# EasyEDA Pro project 第十五届蓝桥杯EDA赛项模拟试题二（嘉立创EDA提供）.eprj, schematic SCH-PockerMultimater1
Create Date: 2024-02-17; Page Name: P1; Project Name: 第十五届蓝桥杯EDA赛项模拟试题二（嘉立创EDA提供）; Schematic Name: SCH-PockerMultimater1; Update Date: 2024-04-05; Company: 深圳嘉立创科技集团股份有限公司; Drawed: LCEDA_02; Page Size: A4; Part Number: JLC-PCB-001; Reviewed: 嘉立创EDA; Version: V1.0
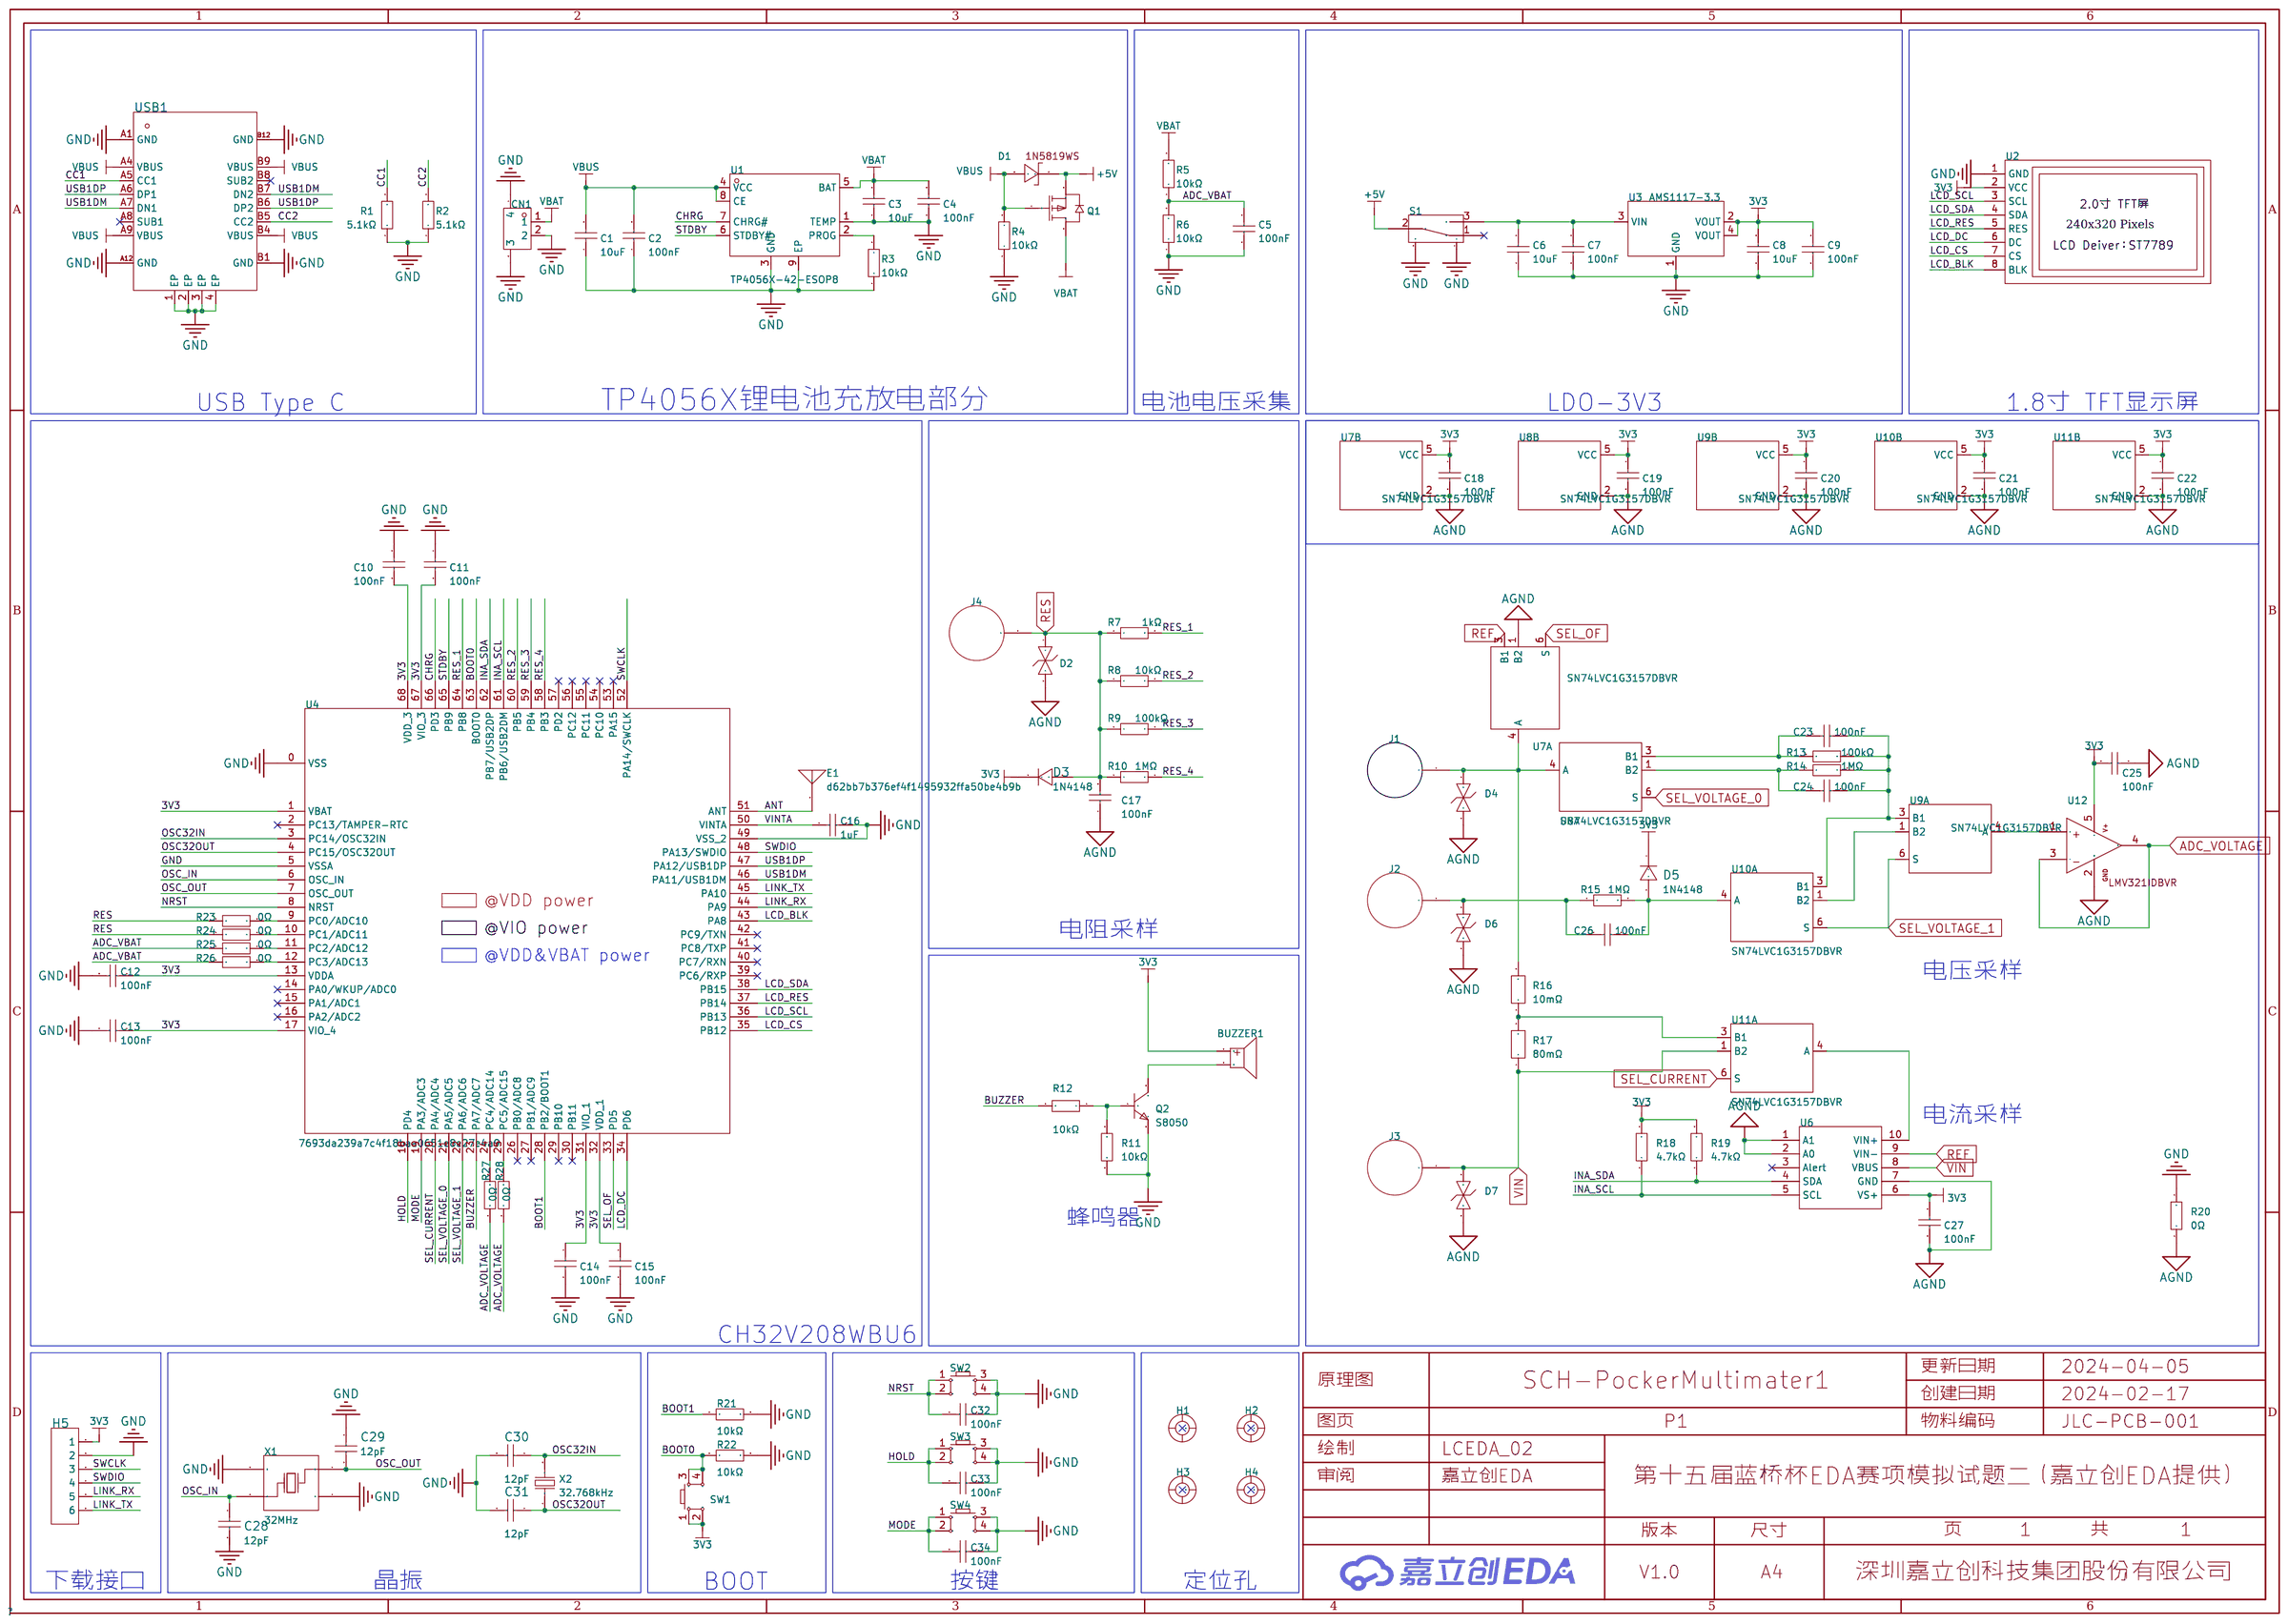
[diagram p0: schematic sheet]

## Parts
BUZZER1  3kHz  [BUZ-TH_BD9.0-P5.00-D0.6-FD]
C1  10uF  [C0603]
C2  100nF  [C0603]
C3  10uF  [C0603]
C4  100nF  [C0603]
C5  100nF  [C0603]
C6  10uF  [C0603]
C7  100nF  [C0603]
C8  10uF  [C0603]
C9  100nF  [C0603]
C10  100nF  [C0603]
C11  100nF  [C0603]
C12  100nF  [C0603]
C13  100nF  [C0603]
C14  100nF  [C0603]
C15  100nF  [C0603]
C16  1uF  [C0603]
C17  100nF  [C0603]
C18  100nF  [C0603]
C19  100nF  [C0603]
C20  100nF  [C0603]
C21  100nF  [C0603]
C22  100nF  [C0603]
C23  100nF  [C0603]
C24  100nF  [C0603]
C25  100nF  [C0603]
C26  100nF  [C0603]
C27  100nF  [C0603]
C28  12pF  [C0603]
C29  12pF  [C0603]
C30  12pF  [C0603]
C31  12pF  [C0603]
C32  100nF  [C0603]
C33  100nF  [C0603]
C34  100nF  [C0603]
CN1  1.5K-BH-2PWB  [CONN-SMD_2P-P1.50_HDGC_1.5K-BH-2PWB]
D1  1N5819WS  [SOD-323_L1.8-W1.3-LS2.5-RD]
D2  SJD12C40L01  [SOD-123_L2.8-W1.8-LS3.7-BI]
D3  1N4148  [SOD-323_L1.8-W1.3-LS2.5-RD]
D4  SJD12C40L01  [SOD-123_L2.8-W1.8-LS3.7-BI]
D5  1N4148  [SOD-323_L1.8-W1.3-LS2.5-RD]
D6  SJD12C40L01  [SOD-123_L2.8-W1.8-LS3.7-BI]
D7  SJD12C40L01  [SOD-123_L2.8-W1.8-LS3.7-BI]
E1  d62bb7b376ef4f1495932ffa50be4b9b  [ANT-F-1-2.4G-1.6]
H1  -  [M3]
H2  -  [M3]
H3  -  [M3]
H4  -  [M3]
H5  2.54-1x6P直针  [HDR-TH_6P-P2.54-V-M-1]
J1  -  [香蕉头-4mm-24.302.*]
J2  -  [香蕉头-4mm-24.302.*]
J3  -  [香蕉头-4mm-24.302.*]
J4  -  [香蕉头-4mm-24.302.*]
Q1  AO3401A  [SOT-23_L2.9-W1.3-P1.90-LS2.4-BR]
Q2  S8050  [SOT-23-3_L3.0-W1.7-P0.95-LS2.9-BR]
R1  5.1kΩ  [R0603]
R2  5.1kΩ  [R0603]
R3  10kΩ  [R0603]
R4  10kΩ  [R0603]
R5  10kΩ  [R0603]
R6  10kΩ  [R0603]
R7  1kΩ  [R0603]
R8  10kΩ  [R0603]
R9  100kΩ  [R0603]
R10  1MΩ  [R0603]
R11  10kΩ  [R0603]
R12  10kΩ  [R0603]
R13  100kΩ  [R0603]
R14  1MΩ  [R0603]
R15  1MΩ  [R0603]
R16  10mΩ  [R2512]
R17  80mΩ  [R2512]
R18  4.7kΩ  [R0603]
R19  4.7kΩ  [R0603]
R20  0Ω  [R0805]
R21  10kΩ  [R0603]
R22  10kΩ  [R0603]
R23  0Ω  [R0402]
R24  0Ω  [R0402]
R25  0Ω  [R0402]
R26  0Ω  [R0402]
R27  0Ω  [R0402]
R28  0Ω  [R0402]
S1  SK-12E12-G5  [SW-TH_SK-12E12-G5]
SW1  TS-1002S-07026C  [KEY-SMD_4P-L6.0-W6.0-P4.50-LS9.0]
SW2  TS-1002S-07026C  [KEY-SMD_4P-L6.0-W6.0-P4.50-LS9.0]
SW3  TS-1002S-07026C  [KEY-SMD_4P-L6.0-W6.0-P4.50-LS9.0]
SW4  TS-1002S-07026C  [KEY-SMD_4P-L6.0-W6.0-P4.50-LS9.0]
U1  TP4056X-42-ESOP8  [TP4056-SOP8]
U2  -  [2.0寸TFT屏幕模块-8Pin]
U3  AMS1117-3.3  [SOT-223-3_L6.5-W3.4-P2.30-LS7.0-BR]
U4  7693da239a7c4f18baa0651e8e27e4a9  [QFN68(8x8)]
U6  INA226AIDGSR  [MSOP-10_L3.0-W3.0-P0.50-LS5.0-BL]
U7  SN74LVC1G3157DBVR  [SOT-23-6_L2.9-W1.6-P0.95-LS2.8-BR]  (sections 1,2)
U8  SN74LVC1G3157DBVR  [SOT-23-6_L2.9-W1.6-P0.95-LS2.8-BR]  (sections 1,2)
U9  SN74LVC1G3157DBVR  [SOT-23-6_L2.9-W1.6-P0.95-LS2.8-BR]  (sections 1,2)
U10  SN74LVC1G3157DBVR  [SOT-23-6_L2.9-W1.6-P0.95-LS2.8-BR]  (sections 1,2)
U11  SN74LVC1G3157DBVR  [SOT-23-6_L2.9-W1.6-P0.95-LS2.8-BR]  (sections 1,2)
U12  LMV321IDBVR  [SOT-23-5_L3.0-W1.7-P0.95-LS2.8-BR]
USB1  KH-TYPE-C-16P  [USB-C-SMD_KH-TYPE-C-16P]
X1  32MHz  [OSC-SMD_4P-L3.2-W2.5-BL]
X2  32.768kHz  [FC-135R_L3.2-W1.5]

## Library data of the parts
BUZZER1 = HNB09A03: 驱动方式:有源(内含驱动线路);构造类型:电磁式;额定电压:3V;工作电压:1.5V~4.5V;消耗电流:30mA;频率:3kHz;声压(SPL):85dB@10cm;直径(φD):9mm;长度:-;宽度:-;高度:5.5mm;工作温度:-20℃~+70℃;; LCSC Part Name: 电磁式有源一体蜂鸣器HNB09A03; Supplier Part: C96102; Manufacturer: 华能; Supplier Footprint: 插件,D=9mm; Datasheet: https://atta.szlcsc.com/upload/public/pdf/source/20170522/1495448326172.pdf; Supplier: LCSC; Oscillator Circuit: 有源(内含驱动线路); Technology Type: 电磁式; Rated Voltage: 3V; Operating Voltage: 1.5V~4.5V; Current Consumption: 30mA; Sound Pressure Level (SPL): 85dB@10cm; Diameter (φD): 9mm; Height: 5.5mm; Operating Temperature: -20℃~+70℃
C1 C3 = CL10A106MA8NRNC: 容值:10uF;精度:±20%;额定电压:25V;材质(温度系数):X5R;; LCSC Part Name: 10uF ±20% 25V; Supplier Part: C96446; Manufacturer: SAMSUNG(三星); Supplier Footprint: 0603; JLCPCB Part Class: 基础库; Datasheet: https://atta.szlcsc.com/upload/public/pdf/source/20170325/1490427913016.pdf; Supplier: LCSC; Tolerance: ±20%; Voltage Rated: 25V; Temperature Coefficient: X5R
C2 C4 = CC0603KRX7R9BB104: 容值:100nF;精度:±10%;额定电压:50V;材质(温度系数):X7R;; LCSC Part Name: 100nF ±10% 50V; Supplier Part: C14663; Manufacturer: YAGEO(国巨); Supplier Footprint: 0603; JLCPCB Part Class: Basic Part; Datasheet: https://atta.szlcsc.com/upload/public/pdf/source/20180910/C282072_33301C7F631E79921B82A8DAC6BCC5B3.pdf; Supplier: LCSC; Tolerance: ±10%; Voltage Rated: 50V; Temperature Coefficient: X7R
C5 C7 C9-C15 C17-C27 C32-C34 = CC0603KRX7R9BB104: 容值:100nF;精度:±10%;额定电压:50V;材质(温度系数):X7R;; LCSC Part Name: 100nF ±10% 50V; Supplier Part: C14663; Manufacturer: YAGEO(国巨); Supplier Footprint: 0603; Datasheet: https://atta.szlcsc.com/upload/public/pdf/source/20180910/C282072_33301C7F631E79921B82A8DAC6BCC5B3.pdf; Supplier: LCSC; Tolerance: ±10%; Voltage Rated: 50V; Temperature Coefficient: X7R
C6 C8 = CL10A106MA8NRNC: 容值:10uF;精度:±20%;额定电压:25V;材质(温度系数):X5R;; LCSC Part Name: 10uF ±20% 25V; Supplier Part: C96446; Manufacturer: SAMSUNG(三星); Supplier Footprint: 0603; Datasheet: https://atta.szlcsc.com/upload/public/pdf/source/20170325/1490427913016.pdf; Supplier: LCSC; Tolerance: ±20%; Voltage Rated: 25V; Temperature Coefficient: X5R
C16 = CL10A105KB8NNNC: 容值:1uF;精度:±10%;额定电压:50V;材质(温度系数):X5R;; LCSC Part Name: 1uF ±10% 50V; Supplier Part: C15849; Manufacturer: SAMSUNG(三星); Supplier Footprint: 0603; Datasheet: https://atta.szlcsc.com/upload/public/pdf/source/20160103/1457707679084.pdf; Supplier: LCSC; Tolerance: ±10%; Voltage Rated: 50V; Temperature Coefficient: X5R
C28-C31 = CL10C120JB8NNNC: 容值:12pF;精度:±5%;额定电压:50V;材质(温度系数):C0G;; LCSC Part Name: 12pF ±5% 50V; Supplier Part: C38523; Manufacturer: SAMSUNG(三星); Supplier Footprint: 0603; Datasheet: https://atta.szlcsc.com/upload/public/pdf/source/20160218/1457707763339.pdf; Supplier: LCSC; Tolerance: ±5%; Voltage Rated: 50V; Temperature Coefficient: C0G
CN1 = 1.5K-BH-2PWB: 1.5间距卧式贴片针座 2P; LCSC Part Name: 1x2P 间距P=1.5mm 卧式 SMT; Supplier Part: C2919592; Manufacturer: HDGC(华德共创); Supplier Footprint: SMD,P=1.5mm; Datasheet: https://atta.szlcsc.com/upload/public/pdf/source/20211115/B8CFA05E67C19F0A682ADA73BF1C4303.pdf; Supplier: LCSC
D1 = 1N5819WS_C191023: 直流反向耐压(Vr):40V;平均整流电流(Io):1A;正向压降(Vf):600mV@1A;; LCSC Part Name: 40V1A600mV@1A; Supplier Part: C191023; Manufacturer: Hottech(合科泰); Supplier Footprint: SOD-323; JLCPCB Part Class: BasicPart; Datasheet: https://atta.szlcsc.com/upload/public/pdf/source/20220428/3CB86FD8D28D653594B4E35F9D5AEFD9.pdf; Supplier: LCSC; Reverse Voltage (Vr): 40V; Average Rectified Current (Io): 1A; Forward Voltage (Vf@If): 600mV@1A
D2 D4 D6 D7 = SJD12C40L01: LCSC Part Name: 双向ESD; Supplier Part: C313287; Manufacturer: Brightking(君耀电子); Supplier Footprint: SOD-123S; JLCPCB Part Class: 扩展库; Datasheet: https://atta.szlcsc.com/upload/public/pdf/source/20190308/C313298_C5F5DA7B871929800C41255070D52D63.pdf; Supplier: LCSC
D3 D5 = 1N4148WS_C2128: 二极管配置:独立式;功率:200mW;直流反向耐压(Vr):100V;平均整流电流(Io):150mA;正向压降(Vf):1.25V@150mA;反向电流(Ir):1uA@75V;反向恢复时间(trr):4ns;工作温度:+150℃@(Tj);; LCSC Part Name: 100V 150mA 4ns T4; Supplier Part: C2128; Manufacturer: CJ(江苏长电/长晶); Supplier Footprint: SOD-323; Supplier: LCSC; Diode Configuration: 独立式; Power Dissipation: 200mW; Reverse Voltage (Vr): 100V; Average Rectified Current (Io): 150mA; Forward Voltage (Vf@If): 1.25V@150mA; Reverse Leakage Current: 1uA@75V; Reverse Recovery Time (trr): 4ns; Operating Temperature: +150℃@(Tj)
E1 = ANTENNA
H1-H4 = M3: Manufacturer: Shuntian(顺天五金); Manufacturer Part: M3x10+6; Supplier Part: C551322; Supplier: LCSC; JLCPCB Part Class: 扩展库
H5 = 2.54-1x6P直针: 排数:单排;总PIN位数:6;间距:2.54mm;插针结构:1x6P;行距:-;安装类型:直插;圆针/方针:方针;额定电流:3A;额定电压:-;配合针长度:-;塑高:-;触头材质:黄铜;触头镀层:-;工作温度范围:-40℃~+105℃;颜色:黑色;; LCSC Part Name: 2.54mm 1x6P 直插 方针; Supplier Part: C37208; Manufacturer: BOOMELE(博穆精密); Supplier Footprint: 直插,P=2.54mm; Supplier: LCSC; Number of Rows: 单排; Number of Pins: 6; Pitch: 2.54mm; Pin Structure: 1x6P; Mounting Type: 直插; Circluar Pins/Square Pins: 方针; Current Rating (Max): 3A; Contact Material: 黄铜; Operating Temperature Range: -40℃~+105℃; Color: 黑色
J1 = 香蕉头-4mm-24.302.2(黑): Supplier: LCSC; Supplier Part: C106271; Manufacturer Part: 24.302.2; Manufacturer: AMASS(艾迈斯); Datasheet: https://atta.szlcsc.com/upload/public/pdf/source/20170413/1492062723503.pdf
J2-J4 = 香蕉头-4mm-24.302.1(红): Supplier: LCSC; Supplier Part: C99100; Manufacturer: AMASS(艾迈斯); Manufacturer Part: 24.302.1; Datasheet: https://atta.szlcsc.com/upload/public/pdf/source/20170413/1492062723503.pdf; JLCPCB Part Class: 扩展库
Q1 = AO3401A_C15127: 类型:P沟道;漏源电压(Vdss):30V;连续漏极电流(Id):4A;功率(Pd):1.4W;导通电阻(RDS(on)@Vgs,Id):44mΩ@10V,4.3A;; LCSC Part Name: P沟道30V4A; Supplier Part: C15127; Manufacturer: AOS; Supplier Footprint: SOT-23-3L; JLCPCB Part Class: BasicPart; Datasheet: https://atta.szlcsc.com/upload/public/pdf/source/20160507/1462613609053.pdf; Supplier: LCSC; Type: P沟道; Drain Source Voltage (Vdss): 30V; Continuous Drain Current (Id): 4A; Power Dissipation (Pd): 1.4W; Drain Source On Resistance (RDS(on)@Vgs,Id): 44mΩ@10V,4.3A; Gate Threshold Voltage (Vgs(th)@Id): 1.3V@250uA
Q2 = S8050 J3Y_C2146: 晶体管类型:NPN;集射极击穿电压(Vceo):25V;集电极电流(Ic):500mA;功率(Pd):300mW;直流电流增益(hFE@Ic,Vce):200@50mA,1V;; LCSC Part Name: NPN 25V 500mA (200-350); Supplier Part: C2146; Manufacturer: CJ(江苏长电/长晶); Supplier Footprint: SOT-23; Datasheet: https://atta.szlcsc.com/upload/public/pdf/source/20140809/1457707209234.pdf; Supplier: LCSC; Transistor Type: NPN; Collector-Emitter Breakdown Voltage (Vceo): 25V; Collector Current (Ic): 500mA; Power Dissipation (Pd): 300mW; Collector Cut-Off Current (Icbo): 100nA; Collector-Emitter Saturation Voltage (VCE(sat)@Ic,Ib): 600mV@500mA,50mA; DC Current Gain (hFE@Ic,Vce): 200@50mA,1V; Transition Frequency (fT): 150MHz; Operating Temperature: +150℃@(Tj)
R1 R2 = 0603WAF5101T5E: 电阻类型:厚膜电阻;阻值:5.1kΩ;精度:±1%;功率:100mW;; LCSC Part Name: 5.1kΩ ±1% 100mW; Supplier Part: C23186; Manufacturer: UNI-ROYAL(厚声); Supplier Footprint: 0603; Datasheet: https://atta.szlcsc.com/upload/public/pdf/source/20200306/C422600_1E6D84923E4A46A82E41ADD87F860B5C.pdf; Supplier: LCSC; Type: 厚膜电阻; Tolerance: ±1%; Power(Watts): 100mW; Temperature Coefficient: ±100ppm/℃; Overload Voltage (Max): 75V; Operating Temperature Range: -55℃~+155℃
R3 R4 = 0603WAF1002T5E: 电阻类型:厚膜电阻;阻值:10kΩ;精度:±1%;功率:100mW;; LCSC Part Name: 厚膜电阻 10kΩ ±1% 100mW; Supplier Part: C25804; Manufacturer: UNI-ROYAL(厚声); Supplier Footprint: 0603; JLCPCB Part Class: 基础库; Datasheet: https://atta.szlcsc.com/upload/public/pdf/source/20200306/C422600_1E6D84923E4A46A82E41ADD87F860B5C.pdf; Supplier: LCSC; Type: 厚膜电阻; Tolerance: ±1%; Power(Watts): 100mW; Temperature Coefficient: ±100ppm/℃; Overload Voltage (Max): 75V; Operating Temperature Range: -55℃~+155℃
R5 R6 R8 = ARG03BTC1002: 电阻类型:薄膜电阻;阻值:10kΩ;精度:±0.1%;功率:100mW;; LCSC Part Name: 10kΩ ±0.1% 100mW; Supplier Part: C309083; Manufacturer: Viking(光颉); Supplier Footprint: 0603; JLCPCB Part Class: 扩展库; Datasheet: https://atta.szlcsc.com/upload/public/pdf/source/20180927/C309083_646512A0E222CA692A136FBD28365627.pdf; Supplier: LCSC; Type: 薄膜电阻; Tolerance: ±0.1%; Power(Watts): 100mW; Temperature Coefficient: ±25ppm/℃; Overload Voltage (Max): 75V; Operating Temperature Range: -55℃~+155℃
R7 = RT0603BRD071KL: 电阻类型:薄膜电阻;阻值:1kΩ;精度:±0.1%;功率:100mW;; LCSC Part Name: 1kΩ ±0.1% 100mW; Supplier Part: C110776; Manufacturer: YAGEO(国巨); Supplier Footprint: 0603; JLCPCB Part Class: 扩展库; Datasheet: https://atta.szlcsc.com/upload/public/pdf/source/20170704/1499151282044.pdf; Supplier: LCSC; Type: 薄膜电阻; Tolerance: ±0.1%; Power(Watts): 100mW; Temperature Coefficient: ±25ppm/℃; Overload Voltage (Max): 75V; Operating Temperature Range: -55℃~+155℃
R9 R13 = RT0603BRD07100KL: 电阻类型:薄膜电阻;阻值:100kΩ;精度:±0.1%;功率:100mW;; LCSC Part Name: 100kΩ ±0.1% 100mW; Supplier Part: C122538; Manufacturer: YAGEO(国巨); Supplier Footprint: 0603; JLCPCB Part Class: 扩展库; Datasheet: https://atta.szlcsc.com/upload/public/pdf/source/20170721/C122538_1500619326323834092.pdf; Supplier: LCSC; Type: 薄膜电阻; Tolerance: ±0.1%; Power(Watts): 100mW; Temperature Coefficient: ±25ppm/℃; Overload Voltage (Max): 75V; Operating Temperature Range: -55℃~+155℃
R10 R14 R15 = ARG03BTC1004: 电阻类型:薄膜电阻;阻值:1MΩ;精度:±0.1%;功率:100mW;; LCSC Part Name: 1MΩ ±0.1% 100mW; Supplier Part: C335092; Manufacturer: Viking(光颉); Supplier Footprint: 0603; JLCPCB Part Class: 扩展库; Datasheet: https://atta.szlcsc.com/upload/public/pdf/source/20181207/C335092_AFEFD710796D6AB4B37DCA95E2A57414.pdf; Supplier: LCSC; Type: 薄膜电阻; Tolerance: ±0.1%; Power(Watts): 100mW; Temperature Coefficient: ±25ppm/℃; Overload Voltage (Max): 75V; Operating Temperature Range: -55℃~+155℃
R11 R12 R21 R22 = 0603WAF1002T5E: 电阻类型:厚膜电阻;阻值:10kΩ;精度:±1%;功率:100mW;; LCSC Part Name: 厚膜电阻 10kΩ ±1% 100mW; Supplier Part: C25804; Manufacturer: UNI-ROYAL(厚声); Supplier Footprint: 0603; Datasheet: https://atta.szlcsc.com/upload/public/pdf/source/20200306/C422600_1E6D84923E4A46A82E41ADD87F860B5C.pdf; Supplier: LCSC; Type: 厚膜电阻; Tolerance: ±1%; Power(Watts): 100mW; Temperature Coefficient: ±100ppm/℃; Overload Voltage (Max): 75V; Operating Temperature Range: -55℃~+155℃
R16 = PE2512FKE070R01L: 阻值:10mΩ;精度:±1%;功率:1W;温度系数:±50ppm/℃;电阻类型:-;; LCSC Part Name: 10mΩ ±1% 1W; Supplier Part: C2093321; Manufacturer: YAGEO(国巨); Supplier Footprint: 2512; JLCPCB Part Class: 扩展库; Datasheet: https://atta.szlcsc.com/upload/public/pdf/source/20211020/C6103334F76DC954DA6F525702694423.pdf; Supplier: LCSC; Tolerance: ±1%; Power(Watts): 1W; Temperature Coefficient: ±50ppm/℃; Operating Temperature Range: -55℃~+170℃
R17 = 25121WF800MT4E: 阻值:80mΩ;精度:±1%;功率:1W;温度系数:±800ppm/℃;电阻类型:厚膜电阻;; LCSC Part Name: 80mΩ ±1% 1W 厚膜电阻; Supplier Part: C421509; Manufacturer: UNI-ROYAL(厚声); Supplier Footprint: 2512; JLCPCB Part Class: 扩展库; Datasheet: https://atta.szlcsc.com/upload/public/pdf/source/20200306/C422600_1E6D84923E4A46A82E41ADD87F860B5C.pdf; Supplier: LCSC; Tolerance: ±1%; Power(Watts): 1W; Overload Voltage (Max): 200V; Temperature Coefficient: ±800ppm/℃; Type: 厚膜电阻; Operating Temperature Range: -55℃~+155℃
R18 R19 = 0603WAF4701T5E: 阻值:4.7kΩ;精度:±1%;功率:100mW;温度系数:±100ppm/℃;电阻类型:厚膜电阻;; LCSC Part Name: 4.7kΩ ±1% 100mW 厚膜电阻; Supplier Part: C23162; Manufacturer: UNI-ROYAL(厚声); Supplier Footprint: 0603; JLCPCB Part Class: Basic Part; Datasheet: https://atta.szlcsc.com/upload/public/pdf/source/20200306/C422600_1E6D84923E4A46A82E41ADD87F860B5C.pdf; Supplier: LCSC; Tolerance: ±1%; Power(Watts): 100mW; Overload Voltage (Max): 75V; Temperature Coefficient: ±100ppm/℃; Type: 厚膜电阻; Operating Temperature Range: -55℃~+155℃
R20 = 0805W8F0000T5E: 阻值:0Ω;精度:±1%;功率:125mW;温度系数:±800ppm/℃;电阻类型:厚膜电阻;; LCSC Part Name: 0Ω ±1% 125mW 厚膜电阻; Supplier Part: C17477; Manufacturer: UNI-ROYAL(厚声); Supplier Footprint: 0805; JLCPCB Part Class: 基础库; Datasheet: https://atta.szlcsc.com/upload/public/pdf/source/20200306/C422600_1E6D84923E4A46A82E41ADD87F860B5C.pdf; Supplier: LCSC; Tolerance: ±1%; Power(Watts): 125mW; Overload Voltage (Max): 150V; Temperature Coefficient: ±800ppm/℃; Type: 厚膜电阻; Operating Temperature Range: -55℃~+155℃
R23-R28 = 0402WGF0000TCE: 阻值:0Ω;精度:±1%;功率:62.5mW;温度系数:±800ppm/℃;电阻类型:厚膜电阻;; LCSC Part Name: 0Ω ±1% 62.5mW 厚膜电阻; Supplier Part: C17168; Manufacturer: UNI-ROYAL(厚声); Supplier Footprint: 0402; JLCPCB Part Class: 基础库; Datasheet: https://atta.szlcsc.com/upload/public/pdf/source/20200306/C422600_1E6D84923E4A46A82E41ADD87F860B5C.pdf; Supplier: LCSC; Tolerance: ±1%; Power(Watts): 62.5mW; Overload Voltage (Max): 50V; Temperature Coefficient: ±800ppm/℃; Type: 厚膜电阻; Operating Temperature Range: -55℃~+155℃
S1 = SK-12E12-G5: 额定电流(DC):-;额定电压(DC):-;额定电流(AC):-;额定电压(AC):-;电路结构:单刀双掷;安装方式:卧插;机械寿命:5千次;; LCSC Part Name: 卧插双档 滑动开关; Supplier Part: C136720; Manufacturer: 韩国韩荣; Supplier Footprint: 插件; JLCPCB Part Class: 扩展库; Datasheet: https://atta.szlcsc.com/upload/public/pdf/source/20210810/880D64C2F8CCE477762EFCC00B7B7681.pdf; Supplier: LCSC; Circuit: 单刀双掷; Mounting Style: 卧插; Mechanical Life: 5千次; Actuator Style: 矩形柱状; Pin Style: PC引脚; Operating Temperature: -25℃~+70℃; Switch Height: 10.6mm
SW1-SW4 = TS-1002S-07026C: 触点电流:50mA;额定电压(DC):12V;电路结构:单刀单掷;安装方式:立贴;带灯:-;机械寿命:-;; LCSC Part Name: 6*6*7mm 立贴 轻触开关; Supplier Part: C455114; Manufacturer: XUNPU(讯普); Supplier Footprint: SMD,6x6mm; JLCPCB Part Class: 扩展库; Datasheet: https://atta.szlcsc.com/upload/public/pdf/source/20191118/C455114_772E06E35D310AADD33EBA639F3876D6.pdf; Supplier: LCSC; Contact Current: 50mA; Voltage Rating (DC): 12V; Circuit: 单刀单掷; Mounting Style: 立贴; Actuator Style: 圆形按钮; Switch Length: 6mm; Switch Width: 6mm; Switch Height: 7mm
U1 = TP4056X-42-ESOP8: Supplier Part: C2763448; Manufacturer: TOPPOWER(南京拓微); Supplier Footprint: SOP-8-EP-150mil; JLCPCB Part Class: 扩展库; Datasheet: https://atta.szlcsc.com/upload/public/pdf/source/20221111/3D7D53D5011BF4ED4C4D0D9BFDBB1404.pdf; Supplier: LCSC
U2 = 2.0英寸TFT屏幕模块-8Pin
U3 = AMS1117-3.3_C6186: 输出类型:固定;输出极性:正;最大输入电压:-;输出电压:3.3V;输出电流:1A;电源纹波抑制比(PSRR):72dB@(120Hz);; LCSC Part Name: 输出3.3V 1A; Supplier Part: 、; Manufacturer: AMS; Supplier Footprint: SOT-223; Datasheet: https://atta.szlcsc.com/upload/public/pdf/source/20180727/C6186_7A095716F0823C02F1997A905E26C086.pdf; Supplier: LCSC; Output Type: 固定; Output Polarity: 正; Number of Outputs: 1; Output Voltage: 3.3V; Dropout Voltage: 1.3V@(800mA); Output Current: 1A; Power Supply Rejection Ratio (PSRR): 72dB@(120Hz)
U4 = CH32V208WBU6: Datasheet: file:///E:/Users/win/Downloads/CH32V208DS0.PDF; Manufacturer: WCH(南京沁恒); Supplier: LCSC; Supplier Part: C5187528
U6 = INA226AIDGSR: INA226 支持报警功能的 36V、双向、超高精度、低侧/高侧、I2C 输出电流/功率监控器; Supplier Part: C49851; Manufacturer: TI(德州仪器); Supplier Footprint: MSOP-10; JLCPCB Part Class: 扩展库; Datasheet: https://www.ti.com/cn/lit/gpn/ina226; Supplier: LCSC; Supply Voltage: 0V~36V; Operating Temperature: -40℃~+125℃
U7-U11 = SN74LVC1G3157DBVR: SN74LVC1G3157 1 通道 2:1 模拟开关; Supplier Part: C10426; Manufacturer: TI(德州仪器); Supplier Footprint: SOT-23-6; Datasheet: https://atta.szlcsc.com/upload/public/pdf/source/20121212/1457706567634.pdf; Supplier: LCSC
U12 = LMV321IDBVR_C7972: 运放类型:General Purpose;放大器组数:1;增益带宽积（GBP）:1MHz;压摆率（SR）:1 V/us;电源电压:2.7V ~ 5.5V, ±1.35V ~ 2.75V;各通道供电电流:130uA;; Supplier Part: C7972; Manufacturer: TI(德州仪器); Supplier Footprint: SOT-23-5; JLCPCB Part Class: 扩展库; Datasheet: https://atta.szlcsc.com/upload/public/pdf/source/20170703/1499081241148.pdf; Supplier: LCSC; Amplifier Type: General Purpose; Number of Circuits: 1; Gain Bandwidth Product（GBP）: 1MHz; Slew Rate（SR）: 1 V/us; Output Type: Rail-to-Rail; Supply Voltage（Single）: 2.7V ~ 5.5V, ±1.35V ~ 2.75V; Iq per channel (Typ): 130uA; Operating Temperature: -40°C ~ 125°C
USB1 = KH-TYPE-C-16P: Type-C母座 16PIN 立式四角贴板无压片; LCSC Part Name: Type-C母座; Supplier Part: C709357; Manufacturer: kinghelm(金航标); Supplier: LCSC
X1 = X322532MMB4SI: 频率:32MHz;频率公差:±10ppm;负载电容:10pF;; LCSC Part Name: 32MHz ±10ppm 10pF YSX321SL; Supplier Part: C113671; Manufacturer: YXC(扬兴晶振); Supplier Footprint: SMD3225-4P; Datasheet: https://atta.szlcsc.com/upload/public/pdf/source/20210329/C112971_1F611BDC486E193C1706F6D8EB5AA189.pdf; Supplier: LCSC; Crystal Type: 贴片无源晶振; Frequency Tolerance: ±10ppm; Frequency Stability: ±30ppm; Load Capacitance: 10pF; Operating Temperature: -40℃~+85℃
X2 = Q13FC1350000400: 频率:32.768kHz;频率公差:±20ppm;负载电容:12.5pF;; LCSC Part Name: 32.768kHz ±20ppm 12.5pF; Supplier Part: C32346; Manufacturer: EPSON(爱普生); Supplier Footprint: SMD3215-2P; Datasheet: https://atta.szlcsc.com/upload/public/pdf/source/20190108/C32346_746D6B07EAF90824457A96480007685F.pdf; Supplier: LCSC; Crystal Type: 贴片无源晶振; Frequency Tolerance: ±20ppm; Load Capacitance: 12.5pF; Equivalent Series Resistance (ESR): 70kΩ; Operating Temperature: -40℃~+85℃

## Nets
3V3: BUZZER1.1 C8.2 C9.1 C10.1 C11.2 C12.1 C13.1 C14.1 C15.1 C18.1 C19.1 C20.1 C21.1 C22.1 C25.1 C27.1 D3.1(K) D5.1(K) H5.1 R18.2 R19.2 SW1.1 SW1.2 U2.2(VCC) U3.2(VOUT) U3.4(VOUT) U4.1(VBAT) U4.13(VDDA) U4.17(VIO_4) U4.31(VIO_1) U4.32(VDD_1) U4.67(VIO_3) U4.68(VDD_3) U6.6(VS+) U7.5(VCC) U8.5(VCC) U9.5(VCC) U10.5(VCC) U11.5(VCC) U12.5(V+)
+5V: D1.1(C) Q1.2(S) S1.2
AGND: C17.1 C18.2 C19.2 C20.2 C21.2 C22.2 C25.2 C27.2 D2.2 D4.2 D6.2 D7.2 R20.1 U6.1(A1) U6.2(A0) U6.7(GND) U7.1(B2) U7.2(GND) U8.2(GND) U9.2(GND) U10.2(GND) U11.2(GND) U12.2(GND)
GND: C1.1 C2.1 C3.1 C4.1 C5.2 C6.1 C7.2 C8.1 C9.2 C10.2 C11.1 C12.2 C13.2 C14.2 C15.2 C16.2 C28.2 C29.1 C30.2 C31.2 C32.1 C33.1 C34.1 CN1.2 CN1.3 CN1.4 H5.2 Q2.2(E) R1.1 R2.1 R3.1 R4.1 R6.1 R11.2 R20.2 R21.2 R22.2 S1.4 S1.5 SW2.3 SW2.4 SW3.3 SW3.4 SW4.3 SW4.4 U1.1(TEMP) U1.3(GND) U1.9(EP) U2.1(GND) U3.1(GND) U4.0(VSS) U4.5(VSSA) U4.49(VSS_2) USB1.1(EP) USB1.2(EP) USB1.3(EP) USB1.4(EP) USB1.A1(GND) USB1.A12(GND) USB1.B1(GND) USB1.B12(GND) X1.2(GND) X1.4(GND)
VBAT: C3.2 C4.2 CN1.1 Q1.3(D) R5.2 U1.5(BAT)
VBUS: C1.2 C2.2 D1.2(A) Q1.1(G) R4.2 U1.4(VCC) U1.8(CE) USB1.A4(VBUS) USB1.A9(VBUS) USB1.B4(VBUS) USB1.B9(VBUS)
VIN: D7.1 J3.1 R17.1 U6.8(VBUS) U11.1(B2)
VINTA: C16.1 U4.50(VINTA)
ADC_VBAT: C5.1 R5.1 R6.2 R25.1 R26.1
ADC_VOLTAGE: R27.1 R28.1 U12.3(-) U12.4(OUT)
ANT: E1.1(A) U4.51(ANT)
BOOT0: R22.1 SW1.3 SW1.4 U4.63(BOOT0)
BOOT1: R21.1 U4.28(PB2/BOOT1)
BUZZER: R12.2 U4.23(PA7/ADC7)
CC1: R1.2 USB1.A5(CC1)
CC2: R2.2 USB1.B5(CC2)
CHRG: U1.7(CHRG#) U4.66(PD3)
HOLD: C33.2 SW3.1 SW3.2 U4.18(PD4)
INA_SCL: R18.1 U4.61(PB6/USB2DM) U6.5(SCL)
INA_SDA: R19.1 U4.62(PB7/USB2DP) U6.4(SDA)
LCD_BLK: U2.8(BLK) U4.43(PA8)
LCD_CS: U2.7(CS) U4.35(PB12)
LCD_DC: U2.6(DC) U4.34(PD6)
LCD_RES: U2.5(RES) U4.37(PB14)
LCD_SCL: U2.3(SCL) U4.36(PB13)
LCD_SDA: U2.4(SDA) U4.38(PB15)
LINK_RX: H5.5 U4.44(PA9)
LINK_TX: H5.6 U4.45(PA10)
MODE: C34.2 SW4.1 SW4.2 U4.19(PA3/ADC3)
NRST: C32.2 SW2.1 SW2.2 U4.8(NRST)
OSC32IN: C30.1 U4.3(PC14/OSC32IN) X2.2
OSC32OUT: C31.1 U4.4(PC15/OSC32OUT) X2.1
OSC_IN: C28.1 U4.6(OSC_IN) X1.3(OSC2)
OSC_OUT: C29.2 U4.7(OSC_OUT) X1.1(OSC1)
REF: U6.9(VIN-) U7.3(B1)
RES: C17.2 D2.1 D3.2(A) J4.1 R7.1 R8.1 R9.1 R10.1 R23.1 R24.1
RES_1: R7.2 U4.64(PB8)
RES_2: R8.2 U4.60(PB5)
RES_3: R9.2 U4.59(PB4)
RES_4: R10.2 U4.58(PB3)
SEL_CURRENT: U4.20(PA4/ADC4) U11.6(S)
SEL_OF: U4.33(PD5) U7.6(S)
SEL_VOLTAGE_0: U4.21(PA5/ADC5) U8.6(S)
SEL_VOLTAGE_1: U4.22(PA6/ADC6) U9.6(S) U10.6(S)
STDBY: U1.6(STDBY#) U4.65(PB9)
SWCLK: H5.3 U4.52(PA14/SWCLK)
SWDIO: H5.4 U4.48(PA13/SWDIO)
USB1DM: U4.46(PA11/USB1DM) USB1.A7(DN1) USB1.B7(DN2)
USB1DP: U4.47(PA12/USB1DP) USB1.A6(DP1) USB1.B6(DP2)
$1N2724: R3.2 U1.2(PROG)
$1N6482: U9.4(A) U12.1(+)
$1N6484: R16.1 R17.2 U11.3(B1)
$1N6487: D4.1 J1.1 R16.2 U7.4(A) U8.4(A)
$1N6488: C26.1 D6.1 J2.1 R15.1
$1N6489: C26.2 D5.2(A) R15.2 U10.4(A)
$1N6490: C24.1 R14.1 U8.1(B2)
$1N6491: C23.1 R13.1 U8.3(B1)
$1N6508: C23.2 C24.2 R13.2 R14.2 U9.3(B1) U10.3(B1)
$1N6517: U9.1(B2) U10.1(B2)
$1N9045: U6.10(VIN+) U11.4(A)
$1N10212: R23.2 U4.9(PC0/ADC10)
$1N10257: R24.2 U4.10(PC1/ADC11)
$1N10302: R25.2 U4.11(PC2/ADC12)
$1N10388: R26.2 U4.12(PC3/ADC13)
$1N10482: R27.2 U4.24(PC4/ADC14)
$1N10485: R28.2 U4.25(PC5/ADC15)
$1N25880: C6.2 C7.1 S1.3 U3.3(VIN)
$1N64534: BUZZER1.2 Q2.3(C)
$1N64552: Q2.1(B) R11.1 R12.1

Not connected (* = marked no-connect by the designer): H1 0*; H2 0*; H3 0*; H4 0*; S1 1*; U4 2(PC13/TAMPER-RTC)* 14(PA0/WKUP/ADC0)* 15(PA1/ADC1)* 16(PA2/ADC2)* 26(PB0/ADC8)* 27(PB1/ADC9)* 29(PB10)* 30(PB11)* 39(PC6/RXP)* 40(PC7/RXN)* 41(PC8/TXP)* 42(PC9/TXN)* 53(PA15)* 54(PC10)* 55(PC11)* 56(PC12)* 57(PD2)*; U6 3(Alert)*; USB1 A8(SUB1)* B8(SUB2)*

## Notes on the sheet
- USB Type C
- TP4056X锂电池充放电部分
- 电池电压采集
- LDO-3V3
- 1.8寸 TFT显示屏
- 电阻采样
- 电压采样
- 电流采样
- 蜂鸣器
- CH32V208WBU6
- 下载接口
- 晶振
- BOOT
- 按键
- 定位孔
